# Altium schematic sheet phototransistors.SchDoc: Phototransostors (part 2 of 3)
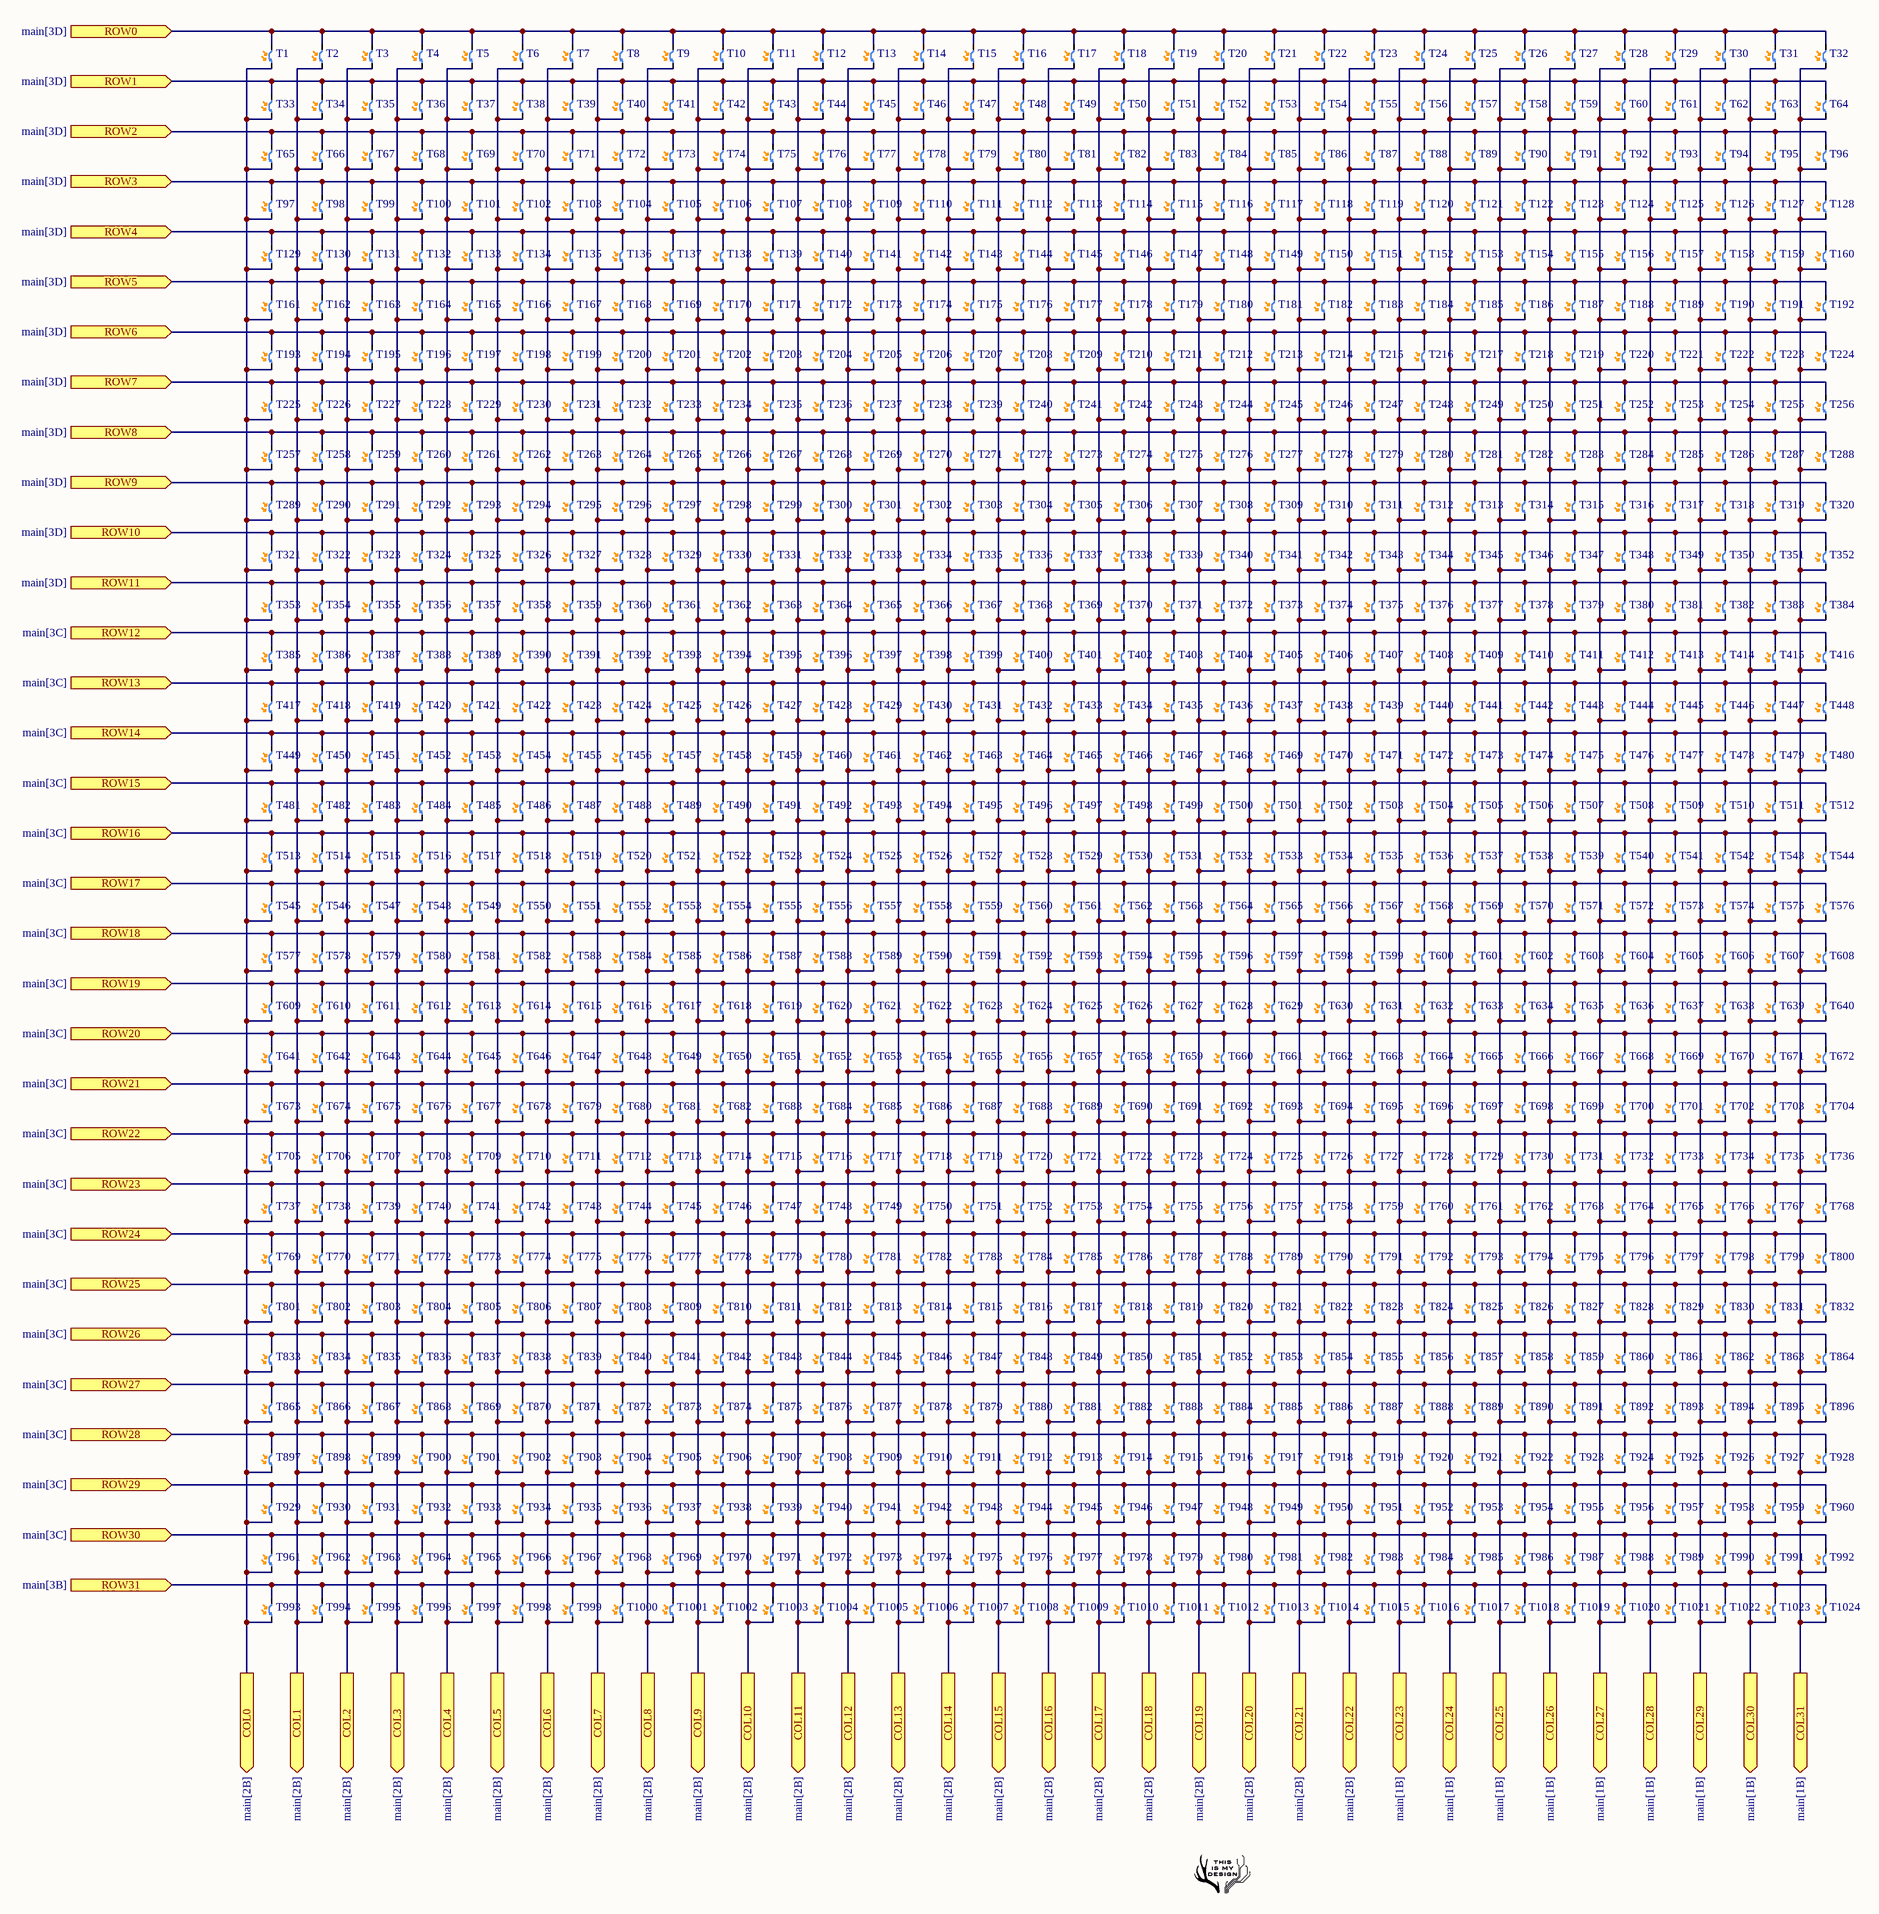
[diagram p1: phototransistors.SchDoc]
## Parts
T1  B19H1PT--H9C000214U1930  [LED0603W]  (value not drawn)
T2  B19H1PT--H9C000214U1930  [LED0603W]  (value not drawn)
T3  B19H1PT--H9C000214U1930  [LED0603W]  (value not drawn)
T4  B19H1PT--H9C000214U1930  [LED0603W]  (value not drawn)
T5  B19H1PT--H9C000214U1930  [LED0603W]  (value not drawn)
T6  B19H1PT--H9C000214U1930  [LED0603W]  (value not drawn)
T7  B19H1PT--H9C000214U1930  [LED0603W]  (value not drawn)
T8  B19H1PT--H9C000214U1930  [LED0603W]  (value not drawn)
T9  B19H1PT--H9C000214U1930  [LED0603W]  (value not drawn)
T10  B19H1PT--H9C000214U1930  [LED0603W]  (value not drawn)
T11  B19H1PT--H9C000214U1930  [LED0603W]  (value not drawn)
T12  B19H1PT--H9C000214U1930  [LED0603W]  (value not drawn)
T13  B19H1PT--H9C000214U1930  [LED0603W]  (value not drawn)
T14  B19H1PT--H9C000214U1930  [LED0603W]  (value not drawn)
T15  B19H1PT--H9C000214U1930  [LED0603W]  (value not drawn)
T16  B19H1PT--H9C000214U1930  [LED0603W]  (value not drawn)
T17  B19H1PT--H9C000214U1930  [LED0603W]  (value not drawn)
T18  B19H1PT--H9C000214U1930  [LED0603W]  (value not drawn)
T19  B19H1PT--H9C000214U1930  [LED0603W]  (value not drawn)
T20  B19H1PT--H9C000214U1930  [LED0603W]  (value not drawn)
T21  B19H1PT--H9C000214U1930  [LED0603W]  (value not drawn)
T22  B19H1PT--H9C000214U1930  [LED0603W]  (value not drawn)
T23  B19H1PT--H9C000214U1930  [LED0603W]  (value not drawn)
T24  B19H1PT--H9C000214U1930  [LED0603W]  (value not drawn)
T25  B19H1PT--H9C000214U1930  [LED0603W]  (value not drawn)
T26  B19H1PT--H9C000214U1930  [LED0603W]  (value not drawn)
T27  B19H1PT--H9C000214U1930  [LED0603W]  (value not drawn)
T28  B19H1PT--H9C000214U1930  [LED0603W]  (value not drawn)
T29  B19H1PT--H9C000214U1930  [LED0603W]  (value not drawn)
T30  B19H1PT--H9C000214U1930  [LED0603W]  (value not drawn)
T31  B19H1PT--H9C000214U1930  [LED0603W]  (value not drawn)
T32  B19H1PT--H9C000214U1930  [LED0603W]  (value not drawn)
T33  B19H1PT--H9C000214U1930  [LED0603W]  (value not drawn)
T34  B19H1PT--H9C000214U1930  [LED0603W]  (value not drawn)
T35  B19H1PT--H9C000214U1930  [LED0603W]  (value not drawn)
T36  B19H1PT--H9C000214U1930  [LED0603W]  (value not drawn)
T37  B19H1PT--H9C000214U1930  [LED0603W]  (value not drawn)
T38  B19H1PT--H9C000214U1930  [LED0603W]  (value not drawn)
T39  B19H1PT--H9C000214U1930  [LED0603W]  (value not drawn)
T40  B19H1PT--H9C000214U1930  [LED0603W]  (value not drawn)
T41  B19H1PT--H9C000214U1930  [LED0603W]  (value not drawn)
T42  B19H1PT--H9C000214U1930  [LED0603W]  (value not drawn)
T43  B19H1PT--H9C000214U1930  [LED0603W]  (value not drawn)
T44  B19H1PT--H9C000214U1930  [LED0603W]  (value not drawn)
T45  B19H1PT--H9C000214U1930  [LED0603W]  (value not drawn)
T46  B19H1PT--H9C000214U1930  [LED0603W]  (value not drawn)
T47  B19H1PT--H9C000214U1930  [LED0603W]  (value not drawn)
T48  B19H1PT--H9C000214U1930  [LED0603W]  (value not drawn)
T49  B19H1PT--H9C000214U1930  [LED0603W]  (value not drawn)
T50  B19H1PT--H9C000214U1930  [LED0603W]  (value not drawn)
T51  B19H1PT--H9C000214U1930  [LED0603W]  (value not drawn)
T52  B19H1PT--H9C000214U1930  [LED0603W]  (value not drawn)
T53  B19H1PT--H9C000214U1930  [LED0603W]  (value not drawn)
T54  B19H1PT--H9C000214U1930  [LED0603W]  (value not drawn)
T55  B19H1PT--H9C000214U1930  [LED0603W]  (value not drawn)
T56  B19H1PT--H9C000214U1930  [LED0603W]  (value not drawn)
T57  B19H1PT--H9C000214U1930  [LED0603W]  (value not drawn)
T58  B19H1PT--H9C000214U1930  [LED0603W]  (value not drawn)
T59  B19H1PT--H9C000214U1930  [LED0603W]  (value not drawn)
T60  B19H1PT--H9C000214U1930  [LED0603W]  (value not drawn)
T61  B19H1PT--H9C000214U1930  [LED0603W]  (value not drawn)
T62  B19H1PT--H9C000214U1930  [LED0603W]  (value not drawn)
T63  B19H1PT--H9C000214U1930  [LED0603W]  (value not drawn)
T64  B19H1PT--H9C000214U1930  [LED0603W]  (value not drawn)
T65  B19H1PT--H9C000214U1930  [LED0603W]  (value not drawn)
T66  B19H1PT--H9C000214U1930  [LED0603W]  (value not drawn)
T67  B19H1PT--H9C000214U1930  [LED0603W]  (value not drawn)
T68  B19H1PT--H9C000214U1930  [LED0603W]  (value not drawn)
T69  B19H1PT--H9C000214U1930  [LED0603W]  (value not drawn)
T70  B19H1PT--H9C000214U1930  [LED0603W]  (value not drawn)
T71  B19H1PT--H9C000214U1930  [LED0603W]  (value not drawn)
T72  B19H1PT--H9C000214U1930  [LED0603W]  (value not drawn)
T73  B19H1PT--H9C000214U1930  [LED0603W]  (value not drawn)
T74  B19H1PT--H9C000214U1930  [LED0603W]  (value not drawn)
T75  B19H1PT--H9C000214U1930  [LED0603W]  (value not drawn)
T76  B19H1PT--H9C000214U1930  [LED0603W]  (value not drawn)
T77  B19H1PT--H9C000214U1930  [LED0603W]  (value not drawn)
T78  B19H1PT--H9C000214U1930  [LED0603W]  (value not drawn)
T79  B19H1PT--H9C000214U1930  [LED0603W]  (value not drawn)
T80  B19H1PT--H9C000214U1930  [LED0603W]  (value not drawn)
T81  B19H1PT--H9C000214U1930  [LED0603W]  (value not drawn)
T82  B19H1PT--H9C000214U1930  [LED0603W]  (value not drawn)
T83  B19H1PT--H9C000214U1930  [LED0603W]  (value not drawn)
T84  B19H1PT--H9C000214U1930  [LED0603W]  (value not drawn)
T85  B19H1PT--H9C000214U1930  [LED0603W]  (value not drawn)
T86  B19H1PT--H9C000214U1930  [LED0603W]  (value not drawn)
T87  B19H1PT--H9C000214U1930  [LED0603W]  (value not drawn)
T88  B19H1PT--H9C000214U1930  [LED0603W]  (value not drawn)
T89  B19H1PT--H9C000214U1930  [LED0603W]  (value not drawn)
T90  B19H1PT--H9C000214U1930  [LED0603W]  (value not drawn)
T91  B19H1PT--H9C000214U1930  [LED0603W]  (value not drawn)
T92  B19H1PT--H9C000214U1930  [LED0603W]  (value not drawn)
T93  B19H1PT--H9C000214U1930  [LED0603W]  (value not drawn)
T94  B19H1PT--H9C000214U1930  [LED0603W]  (value not drawn)
T95  B19H1PT--H9C000214U1930  [LED0603W]  (value not drawn)
T96  B19H1PT--H9C000214U1930  [LED0603W]  (value not drawn)
T97  B19H1PT--H9C000214U1930  [LED0603W]  (value not drawn)
T98  B19H1PT--H9C000214U1930  [LED0603W]  (value not drawn)
T99  B19H1PT--H9C000214U1930  [LED0603W]  (value not drawn)
T100  B19H1PT--H9C000214U1930  [LED0603W]  (value not drawn)
T101  B19H1PT--H9C000214U1930  [LED0603W]  (value not drawn)
T102  B19H1PT--H9C000214U1930  [LED0603W]  (value not drawn)
T103  B19H1PT--H9C000214U1930  [LED0603W]  (value not drawn)
T104  B19H1PT--H9C000214U1930  [LED0603W]  (value not drawn)
T105  B19H1PT--H9C000214U1930  [LED0603W]  (value not drawn)
T106  B19H1PT--H9C000214U1930  [LED0603W]  (value not drawn)
T107  B19H1PT--H9C000214U1930  [LED0603W]  (value not drawn)
T108  B19H1PT--H9C000214U1930  [LED0603W]  (value not drawn)
T109  B19H1PT--H9C000214U1930  [LED0603W]  (value not drawn)
T110  B19H1PT--H9C000214U1930  [LED0603W]  (value not drawn)
T111  B19H1PT--H9C000214U1930  [LED0603W]  (value not drawn)
T112  B19H1PT--H9C000214U1930  [LED0603W]  (value not drawn)
T113  B19H1PT--H9C000214U1930  [LED0603W]  (value not drawn)
T114  B19H1PT--H9C000214U1930  [LED0603W]  (value not drawn)
T115  B19H1PT--H9C000214U1930  [LED0603W]  (value not drawn)
T116  B19H1PT--H9C000214U1930  [LED0603W]  (value not drawn)
T117  B19H1PT--H9C000214U1930  [LED0603W]  (value not drawn)
T118  B19H1PT--H9C000214U1930  [LED0603W]  (value not drawn)
T119  B19H1PT--H9C000214U1930  [LED0603W]  (value not drawn)
T120  B19H1PT--H9C000214U1930  [LED0603W]  (value not drawn)
T121  B19H1PT--H9C000214U1930  [LED0603W]  (value not drawn)
T122  B19H1PT--H9C000214U1930  [LED0603W]  (value not drawn)
T123  B19H1PT--H9C000214U1930  [LED0603W]  (value not drawn)
T124  B19H1PT--H9C000214U1930  [LED0603W]  (value not drawn)
T125  B19H1PT--H9C000214U1930  [LED0603W]  (value not drawn)
T126  B19H1PT--H9C000214U1930  [LED0603W]  (value not drawn)
T127  B19H1PT--H9C000214U1930  [LED0603W]  (value not drawn)
T128  B19H1PT--H9C000214U1930  [LED0603W]  (value not drawn)
T129  B19H1PT--H9C000214U1930  [LED0603W]  (value not drawn)
T130  B19H1PT--H9C000214U1930  [LED0603W]  (value not drawn)
T131  B19H1PT--H9C000214U1930  [LED0603W]  (value not drawn)
T132  B19H1PT--H9C000214U1930  [LED0603W]  (value not drawn)
T133  B19H1PT--H9C000214U1930  [LED0603W]  (value not drawn)
T134  B19H1PT--H9C000214U1930  [LED0603W]  (value not drawn)
T135  B19H1PT--H9C000214U1930  [LED0603W]  (value not drawn)
T136  B19H1PT--H9C000214U1930  [LED0603W]  (value not drawn)
T137  B19H1PT--H9C000214U1930  [LED0603W]  (value not drawn)
T138  B19H1PT--H9C000214U1930  [LED0603W]  (value not drawn)
T139  B19H1PT--H9C000214U1930  [LED0603W]  (value not drawn)
T140  B19H1PT--H9C000214U1930  [LED0603W]  (value not drawn)
T141  B19H1PT--H9C000214U1930  [LED0603W]  (value not drawn)
T142  B19H1PT--H9C000214U1930  [LED0603W]  (value not drawn)
T143  B19H1PT--H9C000214U1930  [LED0603W]  (value not drawn)
T144  B19H1PT--H9C000214U1930  [LED0603W]  (value not drawn)
T145  B19H1PT--H9C000214U1930  [LED0603W]  (value not drawn)
T146  B19H1PT--H9C000214U1930  [LED0603W]  (value not drawn)
T147  B19H1PT--H9C000214U1930  [LED0603W]  (value not drawn)
T148  B19H1PT--H9C000214U1930  [LED0603W]  (value not drawn)
T149  B19H1PT--H9C000214U1930  [LED0603W]  (value not drawn)
T150  B19H1PT--H9C000214U1930  [LED0603W]  (value not drawn)
T151  B19H1PT--H9C000214U1930  [LED0603W]  (value not drawn)
T152  B19H1PT--H9C000214U1930  [LED0603W]  (value not drawn)
T153  B19H1PT--H9C000214U1930  [LED0603W]  (value not drawn)
T154  B19H1PT--H9C000214U1930  [LED0603W]  (value not drawn)
T155  B19H1PT--H9C000214U1930  [LED0603W]  (value not drawn)
T156  B19H1PT--H9C000214U1930  [LED0603W]  (value not drawn)
T157  B19H1PT--H9C000214U1930  [LED0603W]  (value not drawn)
T158  B19H1PT--H9C000214U1930  [LED0603W]  (value not drawn)
T159  B19H1PT--H9C000214U1930  [LED0603W]  (value not drawn)
T160  B19H1PT--H9C000214U1930  [LED0603W]  (value not drawn)
T161  B19H1PT--H9C000214U1930  [LED0603W]  (value not drawn)
T162  B19H1PT--H9C000214U1930  [LED0603W]  (value not drawn)
T163  B19H1PT--H9C000214U1930  [LED0603W]  (value not drawn)
T164  B19H1PT--H9C000214U1930  [LED0603W]  (value not drawn)
T165  B19H1PT--H9C000214U1930  [LED0603W]  (value not drawn)
T166  B19H1PT--H9C000214U1930  [LED0603W]  (value not drawn)
T167  B19H1PT--H9C000214U1930  [LED0603W]  (value not drawn)
T168  B19H1PT--H9C000214U1930  [LED0603W]  (value not drawn)
T169  B19H1PT--H9C000214U1930  [LED0603W]  (value not drawn)
T170  B19H1PT--H9C000214U1930  [LED0603W]  (value not drawn)
T171  B19H1PT--H9C000214U1930  [LED0603W]  (value not drawn)
T172  B19H1PT--H9C000214U1930  [LED0603W]  (value not drawn)
T173  B19H1PT--H9C000214U1930  [LED0603W]  (value not drawn)
T174  B19H1PT--H9C000214U1930  [LED0603W]  (value not drawn)
T175  B19H1PT--H9C000214U1930  [LED0603W]  (value not drawn)
T176  B19H1PT--H9C000214U1930  [LED0603W]  (value not drawn)
T177  B19H1PT--H9C000214U1930  [LED0603W]  (value not drawn)
T178  B19H1PT--H9C000214U1930  [LED0603W]  (value not drawn)
T179  B19H1PT--H9C000214U1930  [LED0603W]  (value not drawn)
T180  B19H1PT--H9C000214U1930  [LED0603W]  (value not drawn)
T181  B19H1PT--H9C000214U1930  [LED0603W]  (value not drawn)
T182  B19H1PT--H9C000214U1930  [LED0603W]  (value not drawn)
T183  B19H1PT--H9C000214U1930  [LED0603W]  (value not drawn)
T184  B19H1PT--H9C000214U1930  [LED0603W]  (value not drawn)
T185  B19H1PT--H9C000214U1930  [LED0603W]  (value not drawn)
T186  B19H1PT--H9C000214U1930  [LED0603W]  (value not drawn)
T187  B19H1PT--H9C000214U1930  [LED0603W]  (value not drawn)
T188  B19H1PT--H9C000214U1930  [LED0603W]  (value not drawn)
T189  B19H1PT--H9C000214U1930  [LED0603W]  (value not drawn)
T190  B19H1PT--H9C000214U1930  [LED0603W]  (value not drawn)
T191  B19H1PT--H9C000214U1930  [LED0603W]  (value not drawn)
T192  B19H1PT--H9C000214U1930  [LED0603W]  (value not drawn)
T193  B19H1PT--H9C000214U1930  [LED0603W]  (value not drawn)
T194  B19H1PT--H9C000214U1930  [LED0603W]  (value not drawn)
T195  B19H1PT--H9C000214U1930  [LED0603W]  (value not drawn)
T196  B19H1PT--H9C000214U1930  [LED0603W]  (value not drawn)
T197  B19H1PT--H9C000214U1930  [LED0603W]  (value not drawn)
T198  B19H1PT--H9C000214U1930  [LED0603W]  (value not drawn)
T199  B19H1PT--H9C000214U1930  [LED0603W]  (value not drawn)
T200  B19H1PT--H9C000214U1930  [LED0603W]  (value not drawn)
T201  B19H1PT--H9C000214U1930  [LED0603W]  (value not drawn)
T202  B19H1PT--H9C000214U1930  [LED0603W]  (value not drawn)
T203  B19H1PT--H9C000214U1930  [LED0603W]  (value not drawn)
T204  B19H1PT--H9C000214U1930  [LED0603W]  (value not drawn)
T205  B19H1PT--H9C000214U1930  [LED0603W]  (value not drawn)
T206  B19H1PT--H9C000214U1930  [LED0603W]  (value not drawn)
T207  B19H1PT--H9C000214U1930  [LED0603W]  (value not drawn)
T208  B19H1PT--H9C000214U1930  [LED0603W]  (value not drawn)
T209  B19H1PT--H9C000214U1930  [LED0603W]  (value not drawn)
T210  B19H1PT--H9C000214U1930  [LED0603W]  (value not drawn)
T211  B19H1PT--H9C000214U1930  [LED0603W]  (value not drawn)
T212  B19H1PT--H9C000214U1930  [LED0603W]  (value not drawn)
T213  B19H1PT--H9C000214U1930  [LED0603W]  (value not drawn)
T214  B19H1PT--H9C000214U1930  [LED0603W]  (value not drawn)
T215  B19H1PT--H9C000214U1930  [LED0603W]  (value not drawn)
T216  B19H1PT--H9C000214U1930  [LED0603W]  (value not drawn)
T217  B19H1PT--H9C000214U1930  [LED0603W]  (value not drawn)
T218  B19H1PT--H9C000214U1930  [LED0603W]  (value not drawn)
T219  B19H1PT--H9C000214U1930  [LED0603W]  (value not drawn)
T220  B19H1PT--H9C000214U1930  [LED0603W]  (value not drawn)
T221  B19H1PT--H9C000214U1930  [LED0603W]  (value not drawn)
T222  B19H1PT--H9C000214U1930  [LED0603W]  (value not drawn)
T223  B19H1PT--H9C000214U1930  [LED0603W]  (value not drawn)
T224  B19H1PT--H9C000214U1930  [LED0603W]  (value not drawn)
T225  B19H1PT--H9C000214U1930  [LED0603W]  (value not drawn)
T226  B19H1PT--H9C000214U1930  [LED0603W]  (value not drawn)
T227  B19H1PT--H9C000214U1930  [LED0603W]  (value not drawn)
T228  B19H1PT--H9C000214U1930  [LED0603W]  (value not drawn)
T229  B19H1PT--H9C000214U1930  [LED0603W]  (value not drawn)
T230  B19H1PT--H9C000214U1930  [LED0603W]  (value not drawn)
T231  B19H1PT--H9C000214U1930  [LED0603W]  (value not drawn)
T232  B19H1PT--H9C000214U1930  [LED0603W]  (value not drawn)
T233  B19H1PT--H9C000214U1930  [LED0603W]  (value not drawn)
T234  B19H1PT--H9C000214U1930  [LED0603W]  (value not drawn)
T235  B19H1PT--H9C000214U1930  [LED0603W]  (value not drawn)
T236  B19H1PT--H9C000214U1930  [LED0603W]  (value not drawn)
T237  B19H1PT--H9C000214U1930  [LED0603W]  (value not drawn)
T238  B19H1PT--H9C000214U1930  [LED0603W]  (value not drawn)
T239  B19H1PT--H9C000214U1930  [LED0603W]  (value not drawn)
T240  B19H1PT--H9C000214U1930  [LED0603W]  (value not drawn)
T241  B19H1PT--H9C000214U1930  [LED0603W]  (value not drawn)
T242  B19H1PT--H9C000214U1930  [LED0603W]  (value not drawn)
T243  B19H1PT--H9C000214U1930  [LED0603W]  (value not drawn)
T244  B19H1PT--H9C000214U1930  [LED0603W]  (value not drawn)
T245  B19H1PT--H9C000214U1930  [LED0603W]  (value not drawn)
T246  B19H1PT--H9C000214U1930  [LED0603W]  (value not drawn)
T247  B19H1PT--H9C000214U1930  [LED0603W]  (value not drawn)
T248  B19H1PT--H9C000214U1930  [LED0603W]  (value not drawn)
T249  B19H1PT--H9C000214U1930  [LED0603W]  (value not drawn)
T250  B19H1PT--H9C000214U1930  [LED0603W]  (value not drawn)
T251  B19H1PT--H9C000214U1930  [LED0603W]  (value not drawn)
T252  B19H1PT--H9C000214U1930  [LED0603W]  (value not drawn)
T253  B19H1PT--H9C000214U1930  [LED0603W]  (value not drawn)
T254  B19H1PT--H9C000214U1930  [LED0603W]  (value not drawn)
T255  B19H1PT--H9C000214U1930  [LED0603W]  (value not drawn)
T256  B19H1PT--H9C000214U1930  [LED0603W]  (value not drawn)
T257  B19H1PT--H9C000214U1930  [LED0603W]  (value not drawn)
T258  B19H1PT--H9C000214U1930  [LED0603W]  (value not drawn)
T259  B19H1PT--H9C000214U1930  [LED0603W]  (value not drawn)
T260  B19H1PT--H9C000214U1930  [LED0603W]  (value not drawn)
T261  B19H1PT--H9C000214U1930  [LED0603W]  (value not drawn)
T262  B19H1PT--H9C000214U1930  [LED0603W]  (value not drawn)
T263  B19H1PT--H9C000214U1930  [LED0603W]  (value not drawn)
T264  B19H1PT--H9C000214U1930  [LED0603W]  (value not drawn)
T265  B19H1PT--H9C000214U1930  [LED0603W]  (value not drawn)
T266  B19H1PT--H9C000214U1930  [LED0603W]  (value not drawn)
T267  B19H1PT--H9C000214U1930  [LED0603W]  (value not drawn)
T268  B19H1PT--H9C000214U1930  [LED0603W]  (value not drawn)
T269  B19H1PT--H9C000214U1930  [LED0603W]  (value not drawn)
T270  B19H1PT--H9C000214U1930  [LED0603W]  (value not drawn)
T271  B19H1PT--H9C000214U1930  [LED0603W]  (value not drawn)
T272  B19H1PT--H9C000214U1930  [LED0603W]  (value not drawn)
T273  B19H1PT--H9C000214U1930  [LED0603W]  (value not drawn)
T274  B19H1PT--H9C000214U1930  [LED0603W]  (value not drawn)
T275  B19H1PT--H9C000214U1930  [LED0603W]  (value not drawn)
T276  B19H1PT--H9C000214U1930  [LED0603W]  (value not drawn)
T277  B19H1PT--H9C000214U1930  [LED0603W]  (value not drawn)
T278  B19H1PT--H9C000214U1930  [LED0603W]  (value not drawn)
T279  B19H1PT--H9C000214U1930  [LED0603W]  (value not drawn)
T280  B19H1PT--H9C000214U1930  [LED0603W]  (value not drawn)
T281  B19H1PT--H9C000214U1930  [LED0603W]  (value not drawn)
T282  B19H1PT--H9C000214U1930  [LED0603W]  (value not drawn)
T283  B19H1PT--H9C000214U1930  [LED0603W]  (value not drawn)
T284  B19H1PT--H9C000214U1930  [LED0603W]  (value not drawn)
T285  B19H1PT--H9C000214U1930  [LED0603W]  (value not drawn)
T286  B19H1PT--H9C000214U1930  [LED0603W]  (value not drawn)
T287  B19H1PT--H9C000214U1930  [LED0603W]  (value not drawn)
T288  B19H1PT--H9C000214U1930  [LED0603W]  (value not drawn)
T289  B19H1PT--H9C000214U1930  [LED0603W]  (value not drawn)
T290  B19H1PT--H9C000214U1930  [LED0603W]  (value not drawn)
T291  B19H1PT--H9C000214U1930  [LED0603W]  (value not drawn)
T292  B19H1PT--H9C000214U1930  [LED0603W]  (value not drawn)
T293  B19H1PT--H9C000214U1930  [LED0603W]  (value not drawn)
T294  B19H1PT--H9C000214U1930  [LED0603W]  (value not drawn)
T295  B19H1PT--H9C000214U1930  [LED0603W]  (value not drawn)
T296  B19H1PT--H9C000214U1930  [LED0603W]  (value not drawn)
T297  B19H1PT--H9C000214U1930  [LED0603W]  (value not drawn)
T298  B19H1PT--H9C000214U1930  [LED0603W]  (value not drawn)
T299  B19H1PT--H9C000214U1930  [LED0603W]  (value not drawn)
T300  B19H1PT--H9C000214U1930  [LED0603W]  (value not drawn)
T301  B19H1PT--H9C000214U1930  [LED0603W]  (value not drawn)
T302  B19H1PT--H9C000214U1930  [LED0603W]  (value not drawn)
T303  B19H1PT--H9C000214U1930  [LED0603W]  (value not drawn)
T304  B19H1PT--H9C000214U1930  [LED0603W]  (value not drawn)
T305  B19H1PT--H9C000214U1930  [LED0603W]  (value not drawn)
T306  B19H1PT--H9C000214U1930  [LED0603W]  (value not drawn)
T307  B19H1PT--H9C000214U1930  [LED0603W]  (value not drawn)
T308  B19H1PT--H9C000214U1930  [LED0603W]  (value not drawn)
T309  B19H1PT--H9C000214U1930  [LED0603W]  (value not drawn)
T310  B19H1PT--H9C000214U1930  [LED0603W]  (value not drawn)
T311  B19H1PT--H9C000214U1930  [LED0603W]  (value not drawn)
T312  B19H1PT--H9C000214U1930  [LED0603W]  (value not drawn)
T313  B19H1PT--H9C000214U1930  [LED0603W]  (value not drawn)
T314  B19H1PT--H9C000214U1930  [LED0603W]  (value not drawn)
T315  B19H1PT--H9C000214U1930  [LED0603W]  (value not drawn)
T316  B19H1PT--H9C000214U1930  [LED0603W]  (value not drawn)
T317  B19H1PT--H9C000214U1930  [LED0603W]  (value not drawn)
T318  B19H1PT--H9C000214U1930  [LED0603W]  (value not drawn)
T319  B19H1PT--H9C000214U1930  [LED0603W]  (value not drawn)
T320  B19H1PT--H9C000214U1930  [LED0603W]  (value not drawn)
T321  B19H1PT--H9C000214U1930  [LED0603W]  (value not drawn)
T322  B19H1PT--H9C000214U1930  [LED0603W]  (value not drawn)
T323  B19H1PT--H9C000214U1930  [LED0603W]  (value not drawn)
T324  B19H1PT--H9C000214U1930  [LED0603W]  (value not drawn)
T325  B19H1PT--H9C000214U1930  [LED0603W]  (value not drawn)
T326  B19H1PT--H9C000214U1930  [LED0603W]  (value not drawn)
T327  B19H1PT--H9C000214U1930  [LED0603W]  (value not drawn)
T328  B19H1PT--H9C000214U1930  [LED0603W]  (value not drawn)
T329  B19H1PT--H9C000214U1930  [LED0603W]  (value not drawn)
T330  B19H1PT--H9C000214U1930  [LED0603W]  (value not drawn)
T331  B19H1PT--H9C000214U1930  [LED0603W]  (value not drawn)
T332  B19H1PT--H9C000214U1930  [LED0603W]  (value not drawn)
T333  B19H1PT--H9C000214U1930  [LED0603W]  (value not drawn)
T334  B19H1PT--H9C000214U1930  [LED0603W]  (value not drawn)
T335  B19H1PT--H9C000214U1930  [LED0603W]  (value not drawn)
T336  B19H1PT--H9C000214U1930  [LED0603W]  (value not drawn)
T337  B19H1PT--H9C000214U1930  [LED0603W]  (value not drawn)
T338  B19H1PT--H9C000214U1930  [LED0603W]  (value not drawn)
T339  B19H1PT--H9C000214U1930  [LED0603W]  (value not drawn)
T340  B19H1PT--H9C000214U1930  [LED0603W]  (value not drawn)
T341  B19H1PT--H9C000214U1930  [LED0603W]  (value not drawn)
T342  B19H1PT--H9C000214U1930  [LED0603W]  (value not drawn)
T343  B19H1PT--H9C000214U1930  [LED0603W]  (value not drawn)
T344  B19H1PT--H9C000214U1930  [LED0603W]  (value not drawn)